# EasyEDA Pro project 立创·天猛星MSPM0G3507开发板.eprj, board PCB (continued)
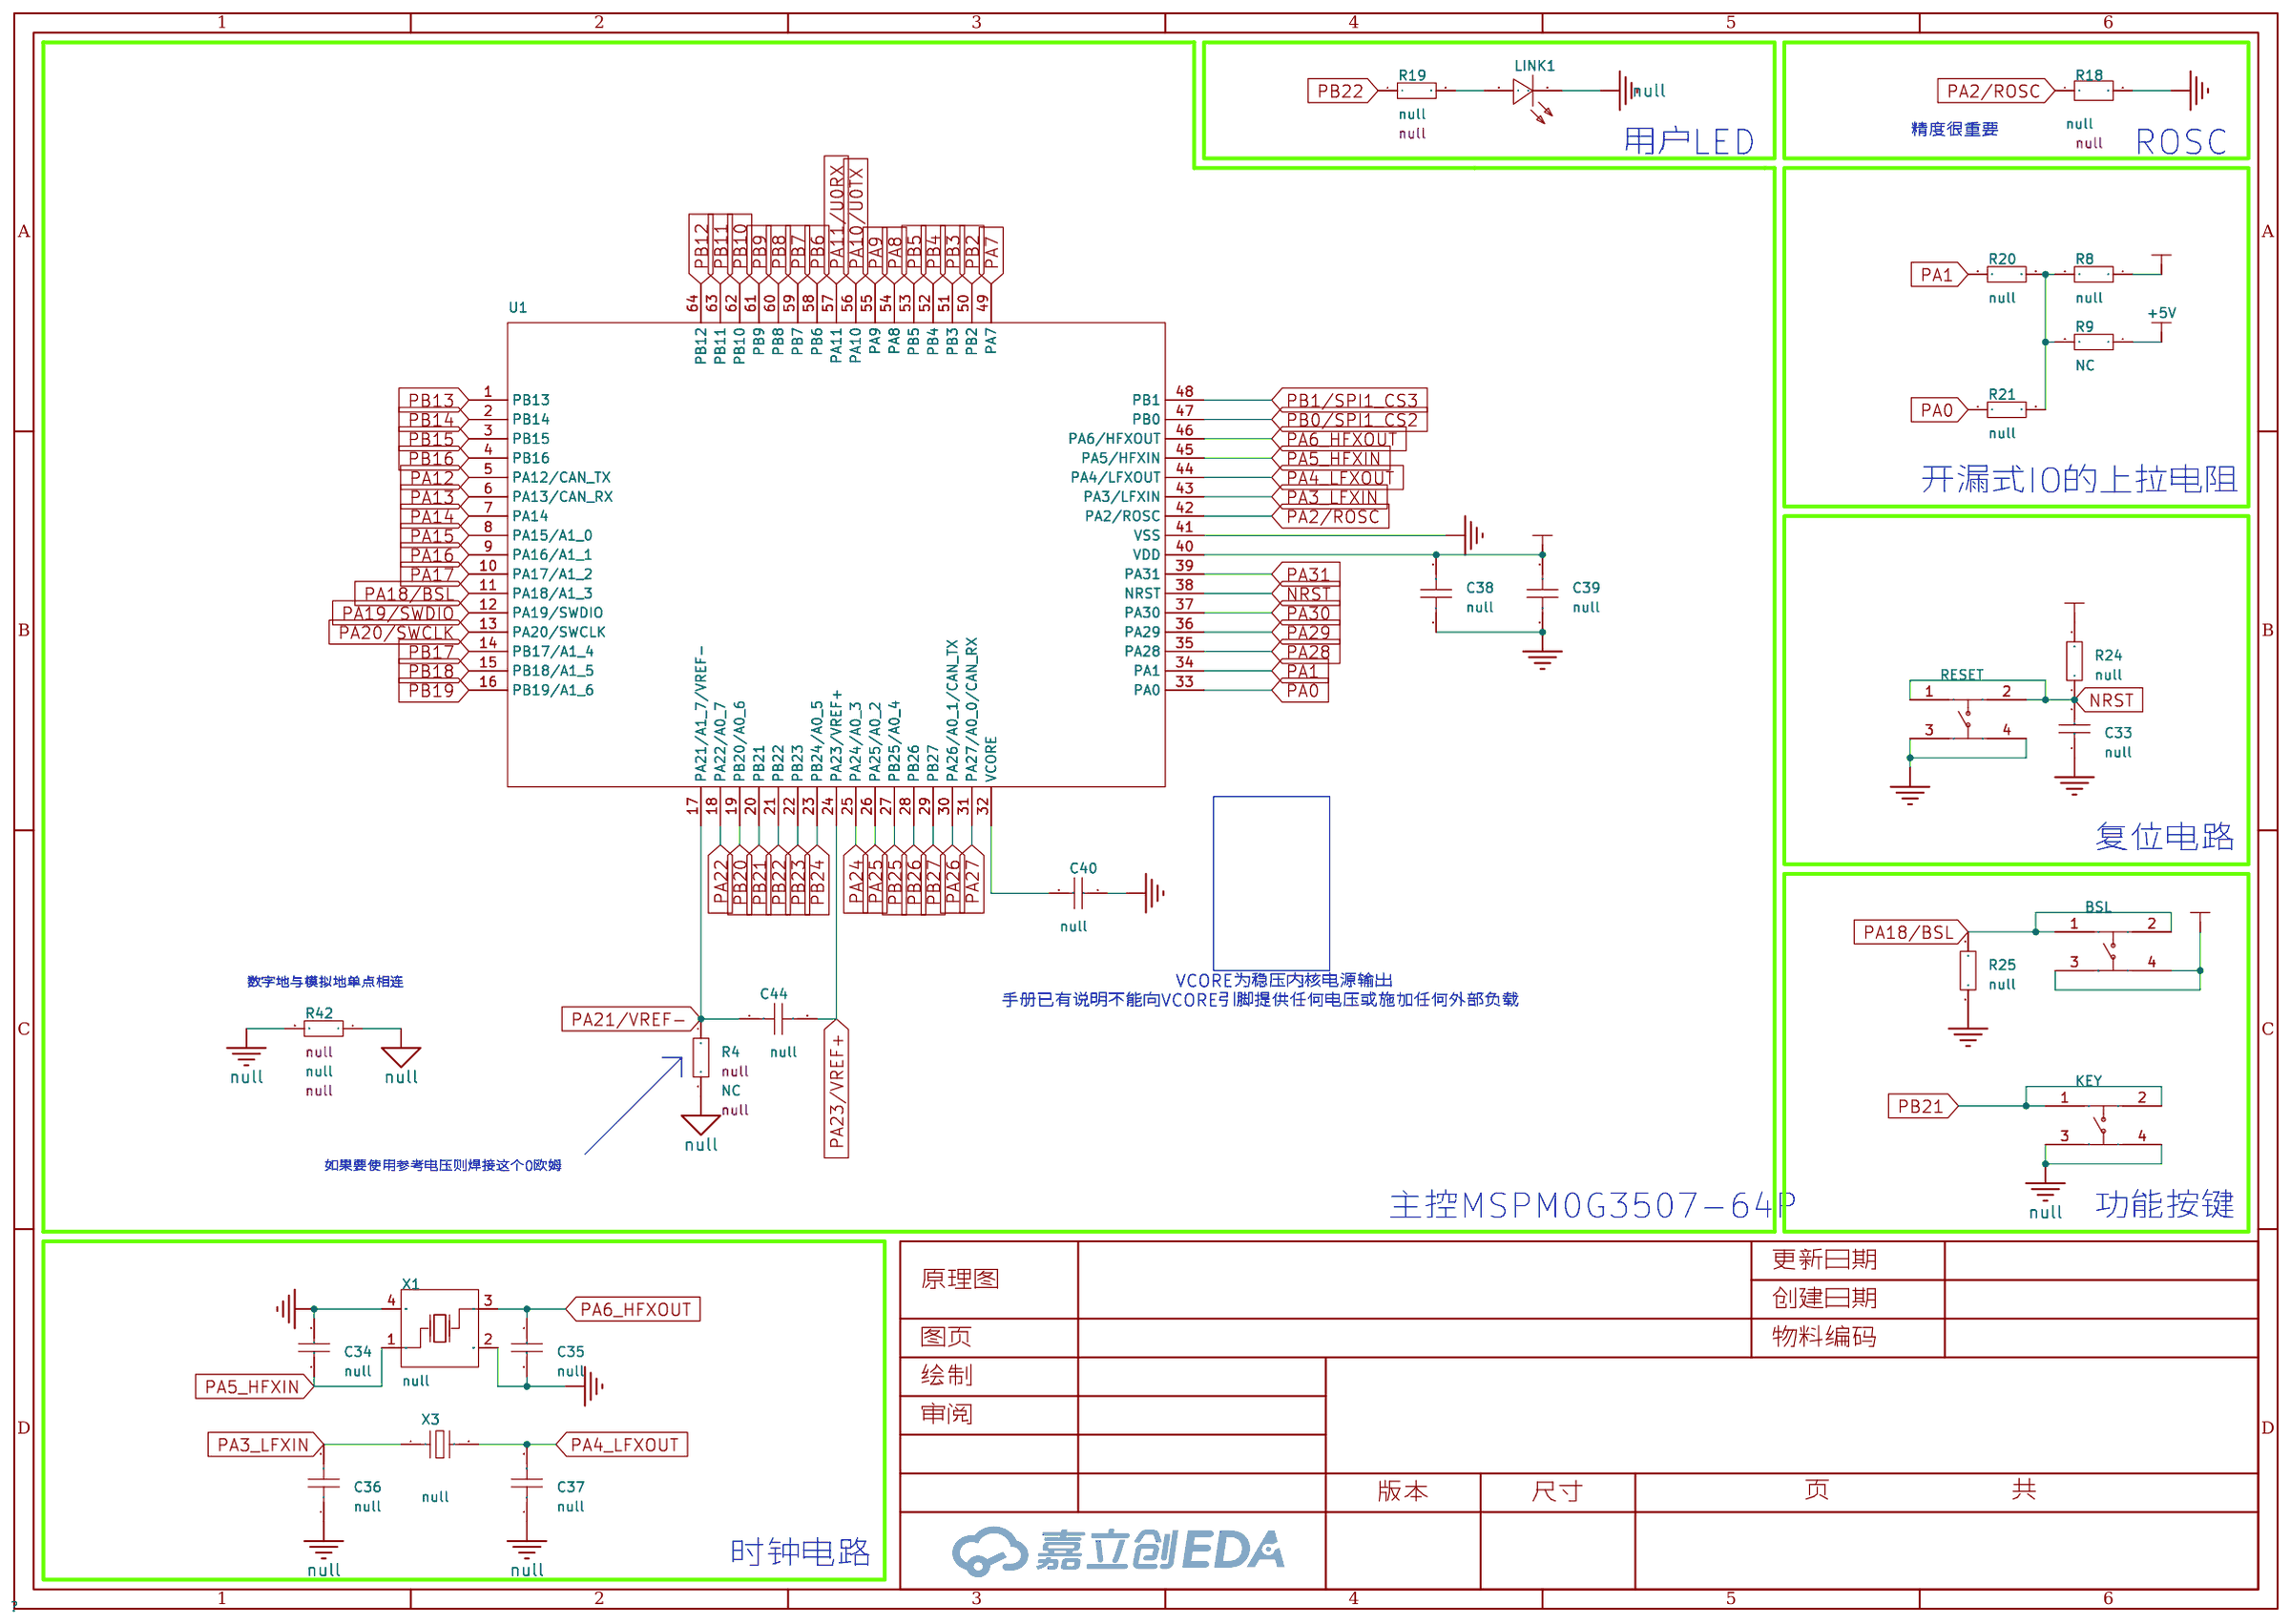
[diagram p0: core]
## Routing (per net, layer and track width the routed paths; a pad name or vN(x,y) marks a point on that pad's centre or on a via; arc(x,y) is an arc through that point) (continued)
  Bottom Layer w0.508: U20.7 v1(8.26,11.18)
  vias: v1(2.85,62.14) v1(2.85,31.66) v1(2.85,11.34) v1(2.85,8.8) v1(2.85,1.18) v1(5.39,8.8) v1(7.5,58.43) v1(7.93,67.22) v1(7.93,8.8) v1(10.47,67.22) v1(13.01,67.22) v1(12.96,58.43) v1(15.03,58.43) v1(15.55,67.22) v1(18.3,58.43) v1(19.31,40.14) v1(19.95,12.96) v1(19.95,11.06) v1(20.46,42.17) v1(20.46,40.14) v1(20.46,38.62) v1(20.63,67.22) v1(20.63,18.96) v1(20.96,58.43) v1(21.22,37.73) v1(21.22,8.01) v1(21.22,6.8) v1(21.22,3.75) v1(21.22,1.15) v1(21.73,40.14) v1(21.69,26.18) v1(21.69,25.34) v1(22.53,26.18) v1(22.53,25.34) v1(23.17,67.22) v1(23.17,1.18) v1(23.38,26.18) v1(23.38,25.34) v1(23.76,12.96) v1(23.88,22.36) v1(24.19,27.02) v1(24.27,36.58) v1(24.52,57.03) v1(25.71,67.22) v1(25.66,47.89) v1(25.71,3.72) v1(25.71,1.18) v1(25.92,22.36) v1(26.3,8.52) v1(26.3,6.84) v1(26.3,5.37) v1(27.31,8.52) v1(27.69,59.82) v1(28.2,18.87) v1(28.2,18.04) v1(28.25,3.72) v1(28.25,1.18) v1(28.33,57.03) v1(28.71,28.07) v1(30.23,59.82) v1(30.79,64.68) v1(30.79,3.72) v1(30.79,1.18) v1(32.27,19.69) v1(33.33,64.68) v1(33.33,62.14) v1(33.33,3.72) v1(33.33,1.18) v1(34.43,19.69) v1(35.87,1.18) v1(36.33,18.42) v1(36.33,15.12) v1(36.33,12.7) v1(36.33,11.31) v1(36.71,59.44) v1(38.41,62.14) v1(38.41,34.2) v1(38.41,31.66) v1(38.41,11.34) v1(38.41,1.18) v1(40.95,59.6) v1(40.95,8.8) v1(43.49,62.14) v1(43.49,59.6) v1(43.49,57.06) v1(43.49,54.52) v1(43.49,51.98) v1(43.49,49.44) v1(43.49,46.9) v1(43.49,44.36) v1(43.49,41.82) v1(43.49,39.28) v1(43.49,36.74) v1(43.49,11.34) v1(43.49,8.8)
VBUS_5V: length 86.5
  Top Layer w0.508: USB1.A4B9 29.32,8.16 28.96,8.52 v1(28.84,8.52) ; 7.5,13.81 v1(7.5,26.3) ; 7.5,13.81 11.15,13.81 v1(12.07,14.74) ; 7.5,13.81 6.03,12.34 ; 41.58,12.34 43.06,13.82 43.06,31.17 U22.24
  Bottom Layer w0.381: U21.24 7.36,31.32 7.36,26.44 v1(7.5,26.3)
  Bottom Layer w0.508: v1(12.07,14.74) 17.15,14.74 18.28,13.61 U20.1 18.28,10.06 18.42,9.91 27.8,9.91 ; 27.8,9.91 27.8,9.3 28.58,8.52 v1(28.84,8.52) ; 27.8,9.91 33.16,9.91 33.79,9.28 v1(34.3,9.28) v1(35.01,9.28) 38.52,9.28 41.58,12.34
340_RX: length 2.5
  Top Layer w0.203: R37.1 12.71,16.78 U18.9
340_TX: length 2.3
  Top Layer w0.203: U18.8 11.82,17.28
BLK: length 96.3
  Top Layer w0.203: U1.28 30.84,39.98 v1(31.12,40.27) ; v1(31.12,43.25) 31.12,43.36 30.77,43.72 30.77,45.37 32.77,47.38 32.77,51.6 32.27,52.11 32.27,58.3 31.49,59.07 H8.8 27.9,65.41 10.68,65.41 9.03,63.76 v1(9.03,52.46) ; U21.32 4.83,23.69 4.83,26.04 5.09,26.3 6.49,26.3 7.25,27.06 v1(8.14,27.06)
  Bottom Layer w0.203: v1(31.12,43.25) v1(31.12,40.27) ; v1(8.14,27.06) 7.86,27.34 7.86,32.16 7.37,32.65 7.37,41.28 9.03,42.93 v1(9.03,52.46)
BSLRX: length 56.1
  Top Layer w0.203: D9.2 v1(9.28,17.28) 8.8,17.76 8.8,25.18 v1(9.91,26.3) ; U21.14 9.27,45.36 10.3,44.33 10.3,40.01 12.32,37.98 U1.57 17.91,37.98 18.42,37.47 v1(18.42,34.68)
  Bottom Layer w0.203: v1(18.42,34.68) 18.42,32.77 17.28,31.63 15.12,31.63 13.72,30.23 13.72,28.33 11.69,26.3 v1(9.91,26.3) ; v1(9.28,17.28) 8.64,16.64 8.64,15.04 9.96,13.72 12.84,13.72 13.2,13.36 U20.5
BSLTX: length 62.3
  Top Layer w0.203: v1(19.28,35.06) 19.28,36.36 18.88,36.76 18.88,37.9 18.3,38.48 U1.56 13.6,38.48 11.31,40.77 11.31,45.98 9.4,47.9 6.03,47.9 ; R37.2 v1(9.28,16.01) 8.39,16.9 8.39,25.53 v1(9.15,26.3)
  Bottom Layer w0.203: U20.3 15.74,13.43 15.06,14.1 10.42,14.1 9.28,15.25 v1(9.28,16.01) ; v1(19.28,35.06) 19.28,32.61 17.94,31.27 15.4,31.27 14.23,30.11 14.23,28.07 11.82,25.66 9.79,25.66 v1(9.15,26.3)
EXT_3V3: length 142.4
  Top Layer w0.381: v1(17.41,54.12) R1.1 R2.2
  Top Layer w0.508: v1(31.38,14.74) v1(27.57,14.74) ; U20.2 18.28,13.87 16.2,15.95 16.2,18.48 v1(16.65,18.93) ; v1(10.8,14.74) v1(8.26,14.74) ; F2.2 v1(22.61,18.8)
  Bottom Layer w0.381: v1(17.41,54.12) 16.15,55.38 8.39,55.38 7.25,54.24 2.42,54.24 1.91,53.73 1.91,36.49 ; 1.91,36.49 1.95,36.46 4.77,36.46 U21.22 ; 1.91,36.49 1.91,14.23 2.55,13.6 4.75,13.6 U21.38 ; U22.38 40.3,13.6 33.28,13.6 32.14,14.74 v1(31.38,14.74)
  Bottom Layer w0.508: U22.22 41.65,35.2 43.57,33.28 43.57,16.87 U22.38 ; v1(10.8,14.74) 14.99,18.93 v1(16.65,18.93) 19.06,18.93 19.82,19.69 21.73,19.69 v1(22.61,18.8) 26.3,18.8 27.57,17.53 v1(27.57,14.74) ; U21.38 6.16,14.74 v1(8.26,14.74)
EXT_CHIP_VREF+: length 31.1
  Top Layer w0.305: R5.2 10.42,23.12 10.8,23.5 v1(14.99,23.5) 15.25,23.25 16.9,23.25 17.8,22.35 C49.2 C50.2 21.35,23.12 26.74,23.12 26.74,22.7
  Bottom Layer w0.305: U21.36 7.64,17.42 8.9,18.68 12.2,18.68 14.99,21.47 v1(14.99,23.5)
EXT_PIN_VREF+: length 42.7
  Top Layer w0.203: v1(34.55,24.9) 33.82,24.16 27.72,24.16 27.44,23.88 21.09,23.88 20.71,23.5 17.58,23.5 16.95,24.14 16.01,24.14 15.38,24.77 15.38,26.93 15.13,27.18 R6.2 ; v1(33.92,34.68) 34.48,35.25 35.63,35.25 36.84,36.46 40.3,36.46 U22.20
  Bottom Layer w0.203: v1(33.92,34.68) 33.92,34.09 34.93,33.07 34.93,25.28 v1(34.55,24.9)
LCD_CS: length 105.6
  Top Layer w0.203: v1(17.79,33.92) 19.19,33.92 19.28,33.82 U1.2 19.28,31.54 20.13,30.69 25.08,30.69 25.54,30.23 28.33,30.23 29.6,28.96 34.93,28.96 36.89,27.01 36.89,22.82 38.49,21.22 40.52,21.22 41.58,20.16 U22.34 ; H8.7 25.74,65.03 11.18,65.03 9.66,63.51 v1(9.66,53.09)
  Bottom Layer w0.203: v1(17.79,33.92) 17.79,32.9 16.9,32.01 14.99,32.01 13.22,30.23 13.22,28.58 11.69,27.06 8.9,27.06 8.16,27.79 8.16,32.79 7.88,33.07 7.88,40.8 9.66,42.58 v1(9.66,53.09)
LCD_DC: length 101.7
  Top Layer w0.203: U22.33 36.51,22.48 36.51,26.5 34.43,28.58 29.47,28.58 28.2,29.85 25.46,29.85 24.93,30.39 19.29,30.39 17.03,32.65 v1(16.39,32.65) 14.64,32.65 14.13,33.15 14.13,34.58 14.54,34.98 U1.63 ; H8.6 23.58,64.65 11.69,64.65 10.3,63.25 v1(10.3,52.46)
  Bottom Layer w0.203: v1(10.3,52.46) 10.3,42.17 8.64,40.52 v1(8.64,29.85) 8.64,28.33 9.41,27.57 11.57,27.57 12.68,28.68 12.68,30.16 14.91,32.39 16.14,32.39 v1(16.39,32.65)
LCD_RES: length 95.6
  Top Layer w0.203: v1(10.93,53.09) 10.93,63 12.07,64.14 21.55,64.14 H8.5 ; v1(35.72,22.36) 36.2,22.84 36.2,26.04 34.4,27.85 34.4,27.89 34.12,28.18 29.37,28.18 28.08,29.47 25.41,29.47 24.8,30.08 19.08,30.08 17.41,31.76 v1(13.6,31.76) 13.6,34.93 14.15,35.48 U1.62
  Bottom Layer w0.203: v1(13.6,31.76) 12.2,30.36 12.2,28.84 11.44,28.07 9.79,28.07 9.15,28.71 v1(9.15,29.22) 9.15,40.01 10.93,41.79 v1(10.93,53.09) ; v1(35.72,22.36) 38.9,22.36 U22.31
LCD_SCL: length 78.2
  Top Layer w0.203: U1.61 13.63,35.98 12.84,35.19 v1(12.84,31.76) 13.47,31.12 16.77,31.12 18.17,29.73 24.14,29.73 v1(24.27,29.6) ; v1(10.17,29.22) 10.17,28.71 9.04,27.58 U21.28 ; U24.6 v1(21.69,27.19) ; H8.3 17.49,63.13 12.58,63.13 12.2,62.75 v1(12.2,53.09)
  Bottom Layer w0.203: v1(24.27,29.6) 23.76,29.6 21.73,27.57 21.73,27.19 ; v1(12.84,31.76) 11.95,31.76 11.18,31 11.18,29.42 10.98,29.22 v1(10.17,29.22) 10.17,39 12.2,41.03 v1(12.2,53.09)
LCD_SDA: length 76.5
  Top Layer w0.203: v1(11.57,52.46) 11.57,62.87 12.33,63.63 19.52,63.63 H8.4 ; U21.27 4.75,28.84 6.99,28.84 7.5,28.33 9.03,28.33 9.66,28.96 v1(9.66,29.85) ; U1.60 13.24,36.48 12.33,35.57 v1(12.33,31.25) 12.96,30.61 16.38,30.61 v1(17.78,29.21) ; 19.52,28.47 v1(19.52,29.22)
  Bottom Layer w0.203: v1(17.78,29.21) 19.51,29.21 v1(19.52,29.22) ; v1(11.57,52.46) 11.57,41.41 9.66,39.5 v1(9.66,29.85) 9.69,29.83 9.69,29.02 10.12,28.58 11.18,28.58 11.69,29.09 11.69,30.61 v1(12.33,31.25)
NRST: length 86.1
  Top Layer w0.203: v1(32.9,58.3) 34.43,59.82 34.43,66.68 33.79,67.32 27.69,67.32 C33.2 26.59,68.42 RESET.2 RESET.1 18.39,68.42 R24.1 ; 33.79,26.8 35.24,25.36 35.24,21.93 v1(36.33,20.84) 36.33,20.12 U22.35 ; v1(29.47,57.03) 30.11,57.03 30.62,56.52 30.62,53.22 30,52.6 30,48.11 27.77,45.88 25.05,45.88 23.78,44.61 U1.38 23.78,42.28 24.9,41.16 24.9,35.38 26.87,33.41 v1(33.92,33.41)
  Bottom Layer w0.203: v1(32.9,58.3) 30.74,58.3 v1(29.47,57.03) ; 33.79,26.8 v1(33.92,26.8) 34.4,27.29 34.4,32.93 v1(33.92,33.41)
PA0: length 53.2
  Top Layer w0.203: v1(25.41,58.81) 30.67,58.81 31.76,57.72 31.76,52.71 31.12,52.08 31.12,47.76 28.33,44.97 26.55,44.97 26.28,44.69 U1.33 ; R21.1 v1(25.41,53.22)
  Bottom Layer w0.203: v1(25.41,53.22) v1(25.41,58.81) 24.9,59.32 4.75,59.32 U21.3
PA1: length 51.5
  Top Layer w0.203: v1(23.63,58.1) 30.57,58.1 31.38,57.3 31.38,52.87 30.7,52.2 30.7,47.85 28.13,45.27 26.22,45.27 25.78,44.83 U1.34 ; R20.1 v1(23.63,53.22)
  Bottom Layer w0.203: U21.5 4.64,56.67 6.5,56.67 6.53,56.65 23.55,56.65 23.63,56.57 ; 23.63,56.57 v1(23.63,53.22) ; 23.63,56.57 v1(23.63,58.1)
PA2/ROSC: length 43.9
  Top Layer w0.203: U22.19 36.85,37.74 v1(34.93,35.82) ; v1(34.93,39.89) 36.58,41.54 v1(36.58,50.3) ; R18.1 27.01,50.55 v1(27.01,50.05) ; U1.42 v1(21.78,42.17)
  Bottom Layer w0.203: 27.01,48.51 v1(27.01,50.05) ; 27.01,48.51 27.01,45.68 23.5,42.17 v1(21.78,42.17) ; 27.01,48.51 34.8,48.51 v1(36.58,50.3) ; v1(34.93,35.82) v1(34.93,39.89)
PA3_LFXIN: length 8.4
  Top Layer w0.203: U1.43 21.28,45.16 21.85,45.73 22.36,45.73 23.88,47.25 C36.2 24.21,48.47 24.65,48.91 X3.1
PA4_LFXOUT: length 7.8
  Top Layer w0.203: X3.2 22.1,49.16 22.79,48.47 C37.2 22.79,46.8 22.11,46.11 21.8,46.11 20.78,45.09 U1.44
PA5_HFXIN: length 8.5
  Top Layer w0.203: U1.45 20.28,45.01 19.44,45.85 19.44,47.2 C34.1 18.55,48.09 18.55,50.05 X1.1
PA6_HFXOUT: length 6.6
  Top Layer w0.203: U1.46 19.78,44.88 17.97,46.69 C35.2 17.97,48.93 X1.3
PA7: length 68.8
  Top Layer w0.203: v1(16.52,45.22) 15.25,46.49 15.25,52.33 15.96,53.04 20.89,53.04 21.5,52.43 28.35,52.43 v1(29.47,51.32) ; v1(15.25,41.92) 15.32,41.98 U1.49 ; v1(28.96,30.87) 30.49,29.34 35.31,29.34 37.22,27.44 37.22,24.77 38.24,23.76 40.32,23.76 U22.32 ; v1(31.63,49.66) 31.63,47.76 29.47,45.6 v1(29.47,42.73)
  Bottom Layer w0.203: v1(29.47,42.73) 29.47,31.38 v1(28.96,30.87) ; v1(29.47,51.32) 29.98,51.32 v1(31.63,49.66) ; v1(15.25,41.92) 16.52,43.19 v1(16.52,45.22)
PA8: length 23.7
  Top Layer w0.203: U1.54 14.25,39.48 12.45,41.28 12.45,47.63 10.3,49.79 v1(7.5,49.79)
  Bottom Layer w0.203: v1(7.5,49.79) 7.5,51.32 7.12,51.7 4.77,51.7 3.49,52.98
PA9: length 21.7
  Top Layer w0.203: U21.9 4.77,49.16 9.66,49.16 11.95,46.87 11.95,41.03 13.99,38.98 U1.55
PA12: length 27.8
  Top Layer w0.203: U1.5 20.78,34.56 v1(21.28,35.06)
  Bottom Layer w0.203: U21.29 4.75,26.3 6.4,26.3 7.79,24.9 11.69,24.9 14.74,27.95 14.74,29.98 15.68,30.92 18.73,30.92 20.69,32.88 20.69,34.47 v1(21.28,35.06)
PA13: length 23.5
  Top Layer w0.203: U1.6 v1(21.28,34.3)
  Bottom Layer w0.203: v1(21.28,34.3) 21.28,32.71 19.19,30.61 16.01,30.61 15.25,29.85 15.25,27.74 11.77,24.26 6.8,24.26 U21.30
PA14: length 27.8
  Top Layer w0.203: v1(24.27,41.03) 21.78,38.54 U1.7
  Bottom Layer w0.203: v1(24.27,41.03) 29.85,46.62 32.39,46.62 33.38,45.63 35.34,45.63 37.61,47.9 39.04,47.9
PA15: length 29.5
  Top Layer w0.203: v1(24.27,40.14) 22.28,38.15 U1.8
  Bottom Layer w0.203: v1(24.27,40.14) 30.11,45.98 32.39,45.98 33.28,45.09 35.95,45.09 37.37,46.51 40.19,46.51 41.58,47.9
PA16: length 25.2
  Top Layer w0.203: v1(24.27,39.31) 22.78,37.83 U1.9
  Bottom Layer w0.203: U22.13 37.36,45.36 36.58,44.58 33.16,44.58 32.38,45.36 30.31,45.36 v1(24.27,39.31)
PA17: length 27
  Top Layer w0.203: v1(24.33,38.42) 23.28,37.38 U1.10
  Bottom Layer w0.203: U22.14 40.3,44.08 32.95,44.08 32.34,44.69 30.32,44.69 24.33,38.69 v1(24.33,38.42)
PA18/BSL: length 96.9
  Top Layer w0.203: v1(32.77,43.57) 33.31,44.1 33.31,46.31 33.92,46.92 33.92,56.78 35.57,58.43 35.57,68.08 34.43,69.22 17.66,69.22 16.85,68.42 BSL.1 9.75,68.42 R25.2 ; U22.36 40.32,18.68 38.36,18.68 37.09,19.95 v1(37.09,20.84) ; 33.79,31.78 28.31,31.78 27.22,30.69 25.59,30.69 25.28,31 24.27,31 23.78,31.48 U1.11 ; v1(35.72,23.38) 35.72,25.76 33.79,27.69
  Bottom Layer w0.203: v1(32.77,43.57) 32.77,38.49 33.44,37.83 33.44,32.27 v1(33.92,31.78) v1(33.92,27.69) ; v1(37.09,20.84) 36.22,21.71 35.33,21.71 34.93,22.11 34.93,22.59 v1(35.72,23.38)
PA19/SWDIO: length 54.5
  Top Layer w0.203: v1(10.68,31.76) 8.9,33.54 8.9,35.95 8.39,36.46 4.77,36.46 U21.19 ; v1(10.68,29.85) 10.68,28.57 8.01,25.9 8.01,16.01 8.77,15.25 12.45,15.25 13.2,14.5 U20.6 ; U1.12 24.28,34.28 v1(24.27,34.3)
  Bottom Layer w0.203: v1(10.68,29.85) v1(10.68,31.76) 11.67,32.75 15.81,32.75 18.76,35.69 22.87,35.69 v1(24.27,34.3)
PA20/SWCLK: length 54.4
  Top Layer w0.203: v1(10.68,32.65) 9.53,33.79 9.53,36.96 8.76,37.74 U21.20 ; U20.4 15.74,19.04 16.46,19.76 17.21,19.76 v1(17.66,20.21) ; v1(24.27,35.06) 24.78,34.54 U1.13 v1(24.78,31.5)
  Bottom Layer w0.203: v1(17.66,20.21) 17.03,20.84 17.03,25.84 17.61,26.42 20.07,26.42 24.78,31.13 v1(24.78,31.5) ; v1(10.68,32.65) 11.08,33.05 15.02,33.05 18.17,36.2 23.12,36.2 v1(24.27,35.06)
PA21/VREF-: length 64.7
  Top Layer w0.203: v1(37.09,32.14) 36.2,31.25 33.26,31.25 33.05,31.45 28.66,31.45 v1(28.08,30.87) ; C44.1 13.22,27.95 15.25,27.95 15.83,27.36 15.83,25.08 16.39,24.52 17.03,24.52 17.53,24.01 v1(20.46,24.01) ; R4.1 v1(21.6,22.35) ; U1.17 32.83,34.48 37.35,39 40.3,39 U22.18
  Bottom Layer w0.203: v1(28.08,30.87) 28.08,24.77 27.31,24.01 21.6,24.01 ; v1(37.09,32.14) 37.6,32.65 37.6,38.11 38.36,38.87 38.54,38.87 38.56,38.89 39.51,38.89 39.53,38.87 40.17,38.87 U22.18 ; v1(20.46,24.01) 21.6,24.01 ; 21.6,24.01 v1(21.6,22.35)
PA22: length 24.8
  Top Layer w0.203: U22.10 40.3,49.16 38.36,49.16 37.88,48.68 37.88,40.29 32.57,34.98 U1.18
PA23/VREF+: length 55.4
  Top Layer w0.203: v1(34.55,24.14) 34.27,23.86 28.05,23.86 27.69,23.5 21.22,23.5 20.84,23.12 17.53,23.12 16.9,23.76 15.42,23.76 14.49,24.69 R6.1 C44.2 10.94,25.67 TP4.1 9.41,24.14 9.41,21.05 9.61,20.84 R5.1 R7.1 ; U1.24 32.91,37.98 v1(33.54,38.62)
  Bottom Layer w0.203: v1(34.55,24.14) 35.39,24.98 35.39,33.33 34.43,34.3 34.43,37.73 v1(33.54,38.62)
PA24: length 27
  Top Layer w0.203: U1.25 32.64,38.48 36.08,41.92 36.08,50.47 36.54,50.93 v1(37.09,50.93)
  Bottom Layer w0.203: v1(37.09,50.93) 37.09,53.35 37.98,54.24 40.3,54.24 U22.6
PA25: length 26.6
  Top Layer w0.203: U22.5 40.39,54.16 40.39,52.2 39.89,51.7 36.46,51.7 35.7,50.93 35.7,42.43 32.25,38.98 U1.26
PA26: length 27
  Top Layer w0.203: U22.4 40.3,56.78 37.35,56.78 34.81,54.24 34.81,43.31 32.48,40.98 U1.30
PA27: length 24.9
  Top Layer w0.203: U22.3 36.72,58.06 34.3,55.63 34.3,43.57 32.21,41.48 U1.31
PA28: length 42.1
  Top Layer w0.203: U1.35 25.28,44.96 25.89,45.57 27.92,45.57 30.36,48.01 30.36,52.46 31,53.09 31,56.81 30.29,57.52 v1(18.3,57.52)
  Bottom Layer w0.203: U21.4 6.56,57.52 v1(18.3,57.52)
PA29: length 38.6
  Top Layer w0.203: v1(25.73,37.54) 25.73,41.6 24.78,42.55 U1.36
  Bottom Layer w0.203: v1(25.73,37.54) 26.81,36.46 26.81,34.17 25.54,32.9 24.01,32.9 20.81,29.7 16.95,29.7 16.54,29.29 16.54,26.83 10.04,20.33 6.4,20.33 U21.34
PA30: length 29.7
  Top Layer w0.203: U1.37 24.28,42.41 25.21,41.49 25.21,35.53 26.82,33.92 34.17,33.92 v1(34.93,34.68)
  Bottom Layer w0.203: v1(34.93,34.68) 35.95,33.66 35.95,28.07 36.45,27.58 U22.27
PA31: length 32.2
  Top Layer w0.203: v1(13.6,56.02) 14.49,55.14 14.49,43.82 15.64,42.67 17.8,42.67 19.06,41.41 22.74,41.41 23.25,41.92 23.25,43.75 U1.39
  Bottom Layer w0.203: v1(13.6,56.02) 7.89,56.02 7.38,55.52 U21.6
PB0/SPI1_CS2: length 64.1
  Top Layer w0.203: v1(29.85,30.87) 31.07,29.65 35.9,29.65 37.58,27.97 37.58,26.5 U22.29 ; v1(29.98,43.31) 29.98,45.6 32.11,47.73 32.11,50.2 v1(31.63,50.68) ; v1(28.58,51.32) 27.77,52.13 21.37,52.13 20.76,52.74 16.54,52.74 15.76,51.95 15.76,46.74 17.28,45.22 v1(17.79,45.22) ; U1.47 v1(19.28,42.17)
  Bottom Layer w0.203: v1(17.79,45.22) 17.79,43.66 v1(19.28,42.17) ; v1(29.98,43.31) 30.01,43.29 30.01,31.02 v1(29.85,30.87) ; v1(31.63,50.68) 30.49,51.82 29.09,51.82 v1(28.58,51.32)
PB1/SPI1_CS3: length 66.4
  Top Layer w0.203: U22.30 40.32,26.3 38.49,26.3 37.88,26.9 37.88,28.43 36.33,29.98 31.63,29.98 v1(30.74,30.87) ; v1(31.63,51.82) 32.42,51.04 32.42,47.53 30.29,45.4 30.29,43.77 30.49,43.57 v1(30.49,42.73) ; v1(29.47,52.33) 28.96,52.33 28.56,52.74 21.65,52.74 21.04,53.35 15.38,53.35 14.87,52.84 14.87,44.97 16.05,43.78 U1.48
  Bottom Layer w0.203: v1(29.47,52.33) 31.12,52.33 v1(31.63,51.82) ; v1(30.49,42.73) 30.49,31.12 v1(30.74,30.87)
PB2: length 35.8
  Top Layer w0.203: U1.50 16.93,41.43 14.97,41.43 14.11,42.3 14.11,54.28 13.65,54.74 v1(13.6,54.74)
  Bottom Layer w0.203: v1(13.6,54.74) 8.9,54.74 8.01,53.86 8.01,45.61 6.47,44.08 4.75,44.08 U21.15
PB3: length 37.4
  Top Layer w0.203: U1.51 14.78,40.98 13.6,42.17 v1(13.6,54.11)
  Bottom Layer w0.203: U21.17 4.75,41.54 6.63,41.54 8.52,43.43 8.52,53.22 9.41,54.11 v1(13.6,54.11)
PB4: length 20.6
  Top Layer w0.203: U1.52 14.52,40.48 13.22,41.79 13.22,49.41 11.05,51.58 7.42,51.58 6.03,52.98
PB5: length 19.4
  Top Layer w0.203: U1.53 14.39,39.98 12.84,41.54 12.84,48.52 10.92,50.44 U21.10
PB6: length 42.6
  Top Layer w0.203: v1(24.14,28.2) 20.96,28.2 v1(20.58,28.58) ; 25.55,24.66 26.95,24.66 v1(27.44,25.15) ; 3.49,30.12 4.64,31.27 11.31,31.27 ; 11.31,31.27 11.31,30.74 12.45,29.6 15.84,29.6 16.85,28.58 17.2,28.58 17.64,28.15 v1(17.64,27.85) ; 11.31,31.27 11.31,36.33 12.47,37.48 U1.58
  Bottom Layer w0.203: v1(27.44,25.15) 27.44,25.53 26.81,26.17 26.81,27.95 26.55,28.2 v1(24.14,28.2) ; v1(20.58,28.58) 19.85,27.85 v1(17.64,27.85)
PB7: length 45
  Top Layer w0.203: 25.55,25.93 26.93,25.93 v1(27.44,26.44) ; v1(17.03,28.07) 16.74,28.07 15.85,28.96 12.25,28.96 10.72,30.49 6.4,30.49 6.03,30.12 ; v1(20.33,29.22) 20.46,29.09 27.31,29.09 v1(27.44,28.96) ; v1(17.03,29.09) 16.01,30.11 12.79,30.11 11.82,31.07 11.82,35.82 12.98,36.98 U1.59
  Bottom Layer w0.203: v1(17.03,29.09) 17.03,28.6 ; 17.03,28.6 17.04,28.58 19.69,28.58 v1(20.33,29.22) ; 17.03,28.6 v1(17.03,28.07) ; v1(27.44,28.96) v1(27.44,26.44)
PB12: length 18.1
  Top Layer w0.203: v1(10.68,34.3) 10.68,37.98 9.03,39.63 9.03,42.04 8.25,42.82 U21.16 ; U1.64 14.8,34.48 v1(14.61,34.3)
  Bottom Layer w0.203: v1(10.68,34.3) v1(14.61,34.3)
PB13: length 18.2
  Top Layer w0.203: v1(10.68,33.54) 10.04,34.17 10.04,37.47 7.24,40.28 U21.18 ; v1(14.61,33.54) 14.87,33.28 18.78,33.28 U1.1
  Bottom Layer w0.203: v1(14.61,33.54) v1(10.68,33.54)
PB15: length 28.5
  Top Layer w0.203: U1.3 19.78,36.75 19.31,37.22 v1(19.31,38.62) ; 3.49,47.9 4.77,46.62 9.28,46.62 10.8,45.09 10.8,40.39 v1(12.58,38.62)
  Bottom Layer w0.203: v1(19.31,38.62) v1(12.58,38.62)
PB16: length 27.1
  Top Layer w0.203: v1(11.57,37.73) 9.66,39.63 9.66,43.7 9.28,44.08 4.77,44.08 U21.13 ; v1(19.82,37.73) 20.28,37.27 U1.4
  Bottom Layer w0.203: v1(11.57,37.73) v1(19.82,37.73)
PB17: length 26.2
  Top Layer w0.203: v1(37.09,33.15) 35.78,33.15 34.89,32.27 28.2,32.27 26.93,31 25.87,31 25.28,31.58 U1.14
  Bottom Layer w0.203: U22.15 37.74,42.82 35.95,41.03 35.95,34.3 v1(37.09,33.15)
PB18: length 25.8
  Top Layer w0.203: v1(37.09,34.68) 36.58,34.68 34.48,32.57 27.75,32.57 26.55,31.38 25.98,31.38 25.78,31.58 U1.15
  Bottom Layer w0.203: v1(37.09,34.68) 36.46,35.31 36.46,40.14 37.85,41.54 40.3,41.54 U22.16
PB19: length 17.5
  Top Layer w0.203: v1(37.09,35.95) 37.09,35.85 34.17,32.93 26.32,32.93 26.28,32.88 U1.16
  Bottom Layer w0.203: U22.17 37.09,38.33 v1(37.09,35.95)
PB20: length 21.9
  Top Layer w0.203: U22.9 37.47,48.87 37.47,40.73 32.23,35.48 U1.19
PB21: length 57
  Top Layer w0.203: v1(32.52,36.46) 32.05,35.98 U1.20 ; v1(32.52,30.87) 38.28,30.87 39.04,30.12 ; v1(31.25,44.2) 31.25,45.35 33.16,47.25 33.16,52.33 32.65,52.84 32.65,56.78 34.93,59.06 34.93,67.83 34.34,68.42 KEY.2 KEY.1
  Bottom Layer w0.203: v1(32.52,30.87) v1(32.52,36.46) 31.63,37.35 31.63,43.82 v1(31.25,44.2)
PB22: length 58.8
  Top Layer w0.203: v1(26.42,20.2) 26.3,20.07 22.87,20.07 v1(21.6,18.8) ; R19.1 20.84,10.16 v1(20.84,12.96) ; 41.58,30.12 40.3,28.84 38.18,28.84 36.63,30.39 32.11,30.39 v1(31.63,30.87) ; U1.21 v1(31.63,36.48)
  Bottom Layer w0.203: v1(21.6,18.8) 21.09,18.3 17.15,18.3 16.65,17.79 16.65,16.14 19.31,13.47 20.2,13.47 20.78,12.89 ; v1(31.63,36.48) v1(31.63,30.87) 31,30.23 31,20.96 30.23,20.2 v1(26.42,20.2)
PB23: length 32.6
  Top Layer w0.203: U1.22 26.7,36.98 26.28,36.57 26.28,36.25 v1(25.73,35.69)
  Bottom Layer w0.203: v1(25.73,35.69) 25.73,34.74 24.8,33.81 23.28,33.81 19.77,30.31 16.34,30.31 15.76,29.73 15.76,27.57 11.95,23.76 4.75,23.76 U21.31
PB24: length 25.6
  Top Layer w0.203: U1.23 33.55,37.48 37.09,41.03 v1(37.09,49.79)
  Bottom Layer w0.203: 41.58,52.98 40.3,51.7 38.11,51.7 37.73,51.32 37.73,50.43 v1(37.09,49.79)
PB25: length 21.9
  Top Layer w0.203: U1.27 31.87,39.48 35.19,42.81 35.19,51.95 36.21,52.98 39.04,52.98
PB27: length 38.1
  Top Layer w0.203: 25.66,36.58 26.3,37.22 26.3,40.01 26.77,40.48 U1.29
  Bottom Layer w0.203: U21.33 4.75,21.22 10.04,21.22 16.14,27.31 16.14,29.47 16.67,30 20.23,30 23.63,33.41 25.28,33.41 26.3,34.42 26.3,36.01 v1(25.73,36.58)
USB_D+: length 25.1
  Top Layer w0.254: v1(32.77,8.64) 32.47,8.34 USB1.B6 ; USB1.A6 31.47,8.64 ; 31.47,8.64 31.47,8.64 v1(30.87,8.64) ; 31.47,8.64 31.47,10.96 31.18,11.25 D1.1 D1.6 27.25,11.25 26.05,12.44 26.05,13.72 25.67,14.1 20.46,14.1 19.59,14.97 19.59,16.01 19.32,16.28 U18.1
  Bottom Layer w0.254: v1(30.87,8.64) 30.87,9.01 31.17,9.31 32.47,9.31 32.77,9 v1(32.77,8.64)
USB_D-: length 25.3
  Top Layer w0.254: USB1.B7 30.97,6.54 31.22,6.29 31.76,6.29 31.97,6.5 USB1.A7 31.97,10.97 31.25,11.69 31.25,12.95 31.05,13.15 D1.3 D1.4 27.43,12.96 26.68,12.96 26.41,13.23 26.41,13.87 25.81,14.46 25.16,14.46 24.86,14.76 24.4,14.76 24.1,14.46 23.64,14.46 23.34,14.76 22.88,14.76 22.58,14.46 22.12,14.46 21.82,14.76 21.35,14.76 21.05,14.46 20.6,14.46 19.95,15.12 19.95,16.39 19.56,16.78 U18.2
$1N2429: length 5.9
  Top Layer w0.381: 29.47,55.87 27.44,55.87 27.19,55.62 R21.2 R20.2
$1N2474: length 16.4
  Top Layer w0.203: C40.1 29.47,48.14 29.24,47.91 v1(28.46,47.91) ; v1(33.79,46.11) 33.79,43.82 31.95,41.98 U1.32
  Bottom Layer w0.203: v1(28.46,47.91) 31.99,47.91 v1(33.79,46.11)
$1N21375: length 2
  Top Layer w0.203: R19.2 LINK1.2
$2N936: length 8.4
  Top Layer w0.203: USB1.A5 30.47,8.36 28.92,9.91 25.41,9.91 24.9,10.42 R28.1
$2N937: length 15.3
  Top Layer w0.203: R27.1 22.61,10.42 23.5,9.53 28.58,9.53 v1(28.84,9.28) ; USB1.B5 33.47,6.55 33.16,6.23 v1(32.77,6.23)
  Bottom Layer w0.203: v1(32.77,6.23) 30.62,6.23 29.98,6.87 29.98,8.14 v1(28.84,9.28)
$2N949: length 10.3
  Top Layer w0.203: U9.5 v1(34.49,15.12) ; v1(35.57,20.84) 34.56,20.84 R14.1 R15.2
  Bottom Layer w0.203: v1(35.57,20.84) 35.57,16.2 v1(34.49,15.12)
$2N956: length 2
  Top Layer w0.203: R29.2 24.9,4.87 PWR1.2
$2N2563: length 19.2
  Top Layer w0.203: v1(17.66,21.72) 17.03,22.35 C11.2 C10.2 R7.2 ; v1(17.54,25.48) 17.54,27.06 17.47,27.12 L2.2 16.52,27.82 15.88,28.46 11.82,28.46 TP2.1
  Bottom Layer w0.203: v1(17.54,25.48) 17.54,21.85 v1(17.66,21.72)
$3N2429: length 9.9
  Top Layer w0.305: H8.1 13.71,57.17 15.26,55.62 R0.1 R1.2
$3N2430: length 10.6
  Top Layer w0.305: H8.2 16.25,57.68 17.15,56.78 18.92,56.78 R2.1 R3.2

## Copper pours and planes (outline as drawn; the poured copper is in the pictures)
3V3 on Top Layer: 31.21,21.6 33.16,21.6 33.41,21.85 33.41,22.92 31.21,22.92
3V3 on Top Layer: 20.22,17.09 19.88,16.75 19.88,15.57 20.2,15.25 31.12,15.25 31.5,15.63 31.5,16.88 31.3,17.09
+5V on Top Layer: 33.42,10.47 33.12,10.17 32.39,10.17 31.89,10.68 31.89,16.64 32.27,17.03 33.16,17.03 33.42,16.76
GND on Top Layer: 24.65,19.82 23.88,19.06 23.88,17.75 24.36,17.28 28.2,17.28 28.46,17.53 28.46,18.93 28.71,19.18 32.77,19.18 33.03,18.93 33.03,17.28 33.41,16.9 33.41,12.33 33.66,12.07 35.44,12.07 35.7,11.82 35.7,8.77 34.92,8 34.92,5.99 35.36,5.55 36.58,5.55 37.09,6.06 37.09,18.68 35.95,19.82
GND on Top Layer: -2.99,73.01 47.01,73.01 47.01,-1.99 -2.99,-1.99
GND on Bottom Layer: -1.99,72.01 47.01,72.01 47.01,-2.99 -1.99,-2.99
VBUS_5V on Top Layer: 35.31,11.95 33.92,11.95 33.54,11.56 33.54,6.87 33.79,6.61 34.43,6.61 34.55,6.74 34.55,7.88 35.57,8.9 35.57,11.69
$2N948 on Top Layer: 33.03,17.76 33.03,18.81 32.77,19.07 28.87,19.07 28.73,18.92 28.73,17.66 28.86,17.53 32.8,17.53

## Text on the board
Bottom Solder Mask Layer: [V1.0.2]
Bottom Silkscreen Layer: AGND | GND | 5V | RX | TX | CHIP | B23 | DIO | A01 | B27 | B03 | B15 | B08 | B02 | B16 | B06 | A12 | A00 | A09 | A08 | B07 | B05 | B04 | A31 | CLK | A29 | B09 | 3V3 | B26 | B13 | B12 | A28 | A13 | A10 | A11 | B21 | RST | B10 | B11 | B17 | B25 | B20 | B19 | B00 | A27 | A25 | A02 | A14 | A30 | A16 | B01 | A21 | B14 | B22 | B24 | A17 | B18 | A07 | A23 | A15 | A22 | A24 | A26 | A18 | 以培养中国工程师为己任 | 不靠卖板赚钱 | PA0/1上拉电压 | R0 | R2 | R1 | R3 | √ | x | R4 | R8 | R5 | R9 | R6 | R7 | PIN | NULL | VDDA | INPUT | VOL | +5V | P1电压 | P2电压 | 参考电压选择 | 表示特殊引脚非必要勿使用
Top Silkscreen Layer: B22 | PWR | P1 | P2 | SCL | SDA | RES | DC | CS | BLK | GND | DIO | CLK | 3V3 | MSPM0G3507 | 立创开发板 | BSL | RST | B21 | 立  创      天  猛  星
